# EAGLE board BMS-HVver2.0 (EAGLE 7.6.0), part 1 of 2 (continued)
## Placement (x,y rotation side) (continued)
R188  0  [0603]  30.73,11.96 90 top
R189  16  [RR02J16RTB]  3.17,29.35 180 top
R190  16  [RR02J16RTB]  6.98,32.53 0 top
R191  16  [RR02J16RTB]  3.17,35.7 180 top
R192  16  [RR02J16RTB]  6.98,38.88 0 top
R193  16  [RR02J16RTB]  3.17,42.05 180 top
R194  16  [RR02J16RTB]  6.98,45.23 0 top
R195  16  [RR02J16RTB]  3.17,48.41 180 top
R196  16  [RR02J16RTB]  6.98,51.58 0 top
R197  16  [RR02J16RTB]  3.17,54.76 180 top
R198  16  [RR02J16RTB]  6.98,57.93 0 top
R199  16  [RR02J16RTB]  3.17,61.1 180 top
R200  16  [RR02J16RTB]  6.98,64.28 0 top
R201  16  [RR02J16RTB]  2.54,67.45 180 top
R202  16  [RR02J16RTB]  6.35,70.63 0 top
R203  16  [RR02J16RTB]  2.54,73.81 180 top
R204  16  [RR02J16RTB]  6.35,76.98 0 top
R205  16  [RR02J16RTB]  2.54,80.16 180 top
R206  16  [RR02J16RTB]  6.35,83.33 0 top
R207  16  [RR02J16RTB]  2.54,86.5 180 top
R208  16  [RR02J16RTB]  6.35,89.68 0 top
R209  16  [RR02J16RTB]  2.54,92.86 180 top
R210  16  [RR02J16RTB]  6.35,96.03 0 top
R211  16  [RR02J16RTB]  6.35,102.38 0 top
R212  16  [RR02J16RTB]  2.54,99.2 180 top
R213  1K  [0603]  40.92,55.72 90 top
R214  10K  [MNR14]  44.58,49.27 270 top
R215  100K  [0603]  44.17,55.72 90 top
R216  1.2K  [0603]  47.47,73.53 90 top
R217  787  [0805]  47.47,70.07 90 top
R218  10K-NTC  [NTC-NXRT15XH103FA5B]  37.47,96.28 90 top
R219  10K-NTC  [NTC-NXRT15XH103FA5B]  26.54,69.87 90 top
R220  10K-NTC  [NTC-NXRT15XH103FA5B]  37.47,43.71 90 top
R221  10K-NTC  [NTC-NXRT15XH103FA5B]  26.8,17.29 90 top
SJ1  [PAD-JUMPER-3-NO_YES_SILK]  141.66,43.66 0 top
SJ2  [PAD-JUMPER-3-NO_YES_SILK]  141.66,41.12 0 top
SJ3  [PAD-JUMPER-3-NO_YES_SILK]  141.66,38.58 0 top
SJ4  [PAD-JUMPER-3-NO_YES_SILK]  141.66,36.04 0 top
SJ5  [PAD-JUMPER-2-NO_YES_SILK]  141.22,32.91 0 top
SJ6  [PAD-JUMPER-3-NO_YES_SILK]  100.79,76.52 0 top
SJ7  [PAD-JUMPER-3-NO_YES_SILK]  100.79,73.98 0 top
SJ8  [PAD-JUMPER-3-NO_YES_SILK]  100.79,71.27 0 top
SJ9  [PAD-JUMPER-3-NO_YES_SILK]  100.79,68.72 0 top
SJ10  [PAD-JUMPER-2-NO_YES_SILK]  100.33,66.19 90 top
SJ11  [PAD-JUMPER-3-NO_YES_SILK]  45.06,84.85 0 top
SJ12  [PAD-JUMPER-3-NO_YES_SILK]  45.06,82.14 0 top
SJ13  [PAD-JUMPER-3-NO_YES_SILK]  45.06,79.42 0 top
SJ14  [PAD-JUMPER-3-NO_YES_SILK]  45.06,76.7 0 top
SJ15  [PAD-JUMPER-2-NO_YES_SILK]  44.65,71.16 90 top
TX1  PE-68386NLT  [PE-68386NLT]  147.12,101.75 0 top
TX2  PE-68386NLT  [PE-68386NLT]  146.94,92.22 0 top
TX3  PE-68386NLT  [PE-68386NLT]  147.12,82.69 0 top
U1  LTC6804-2  [SSOP-48]  140.18,65.93 270 top
U2  LTC6804-2  [SSOP-48]  91.44,66.82 270 top
U3  LTC6804-2  [SSOP-48]  37.08,71.27 270 top
U$1  POGOPIN  [POGOPIN]  125.65,11.12 0 top
U$2  POGOPIN  [POGOPIN]  116.08,18.64 0 top
U$3  POGOPIN  [POGOPIN]  126.9,27.37 0 top
U$4  POGOPIN  [POGOPIN]  116.08,36.14 0 top
U$5  POGOPIN  [POGOPIN]  126.92,44.9 0 top
U$6  POGOPIN  [POGOPIN]  116.08,53.64 0 top
U$7  POGOPIN  [POGOPIN]  126.92,62.38 0 top
U$8  POGOPIN  [POGOPIN]  116.08,71.14 0 top
U$9  POGOPIN  [POGOPIN]  126.92,79.88 0 top
U$10  POGOPIN  [POGOPIN]  116.05,88.61 0 top
U$11  POGOPIN  [POGOPIN]  126.92,97.38 0 top
U$12  POGOPIN  [POGOPIN]  116.08,106.11 0 top
U$13  POGOPIN  [POGOPIN]  125.68,113.63 0 top
U$14  POGOPIN  [POGOPIN]  34.87,11.12 0 top
U$15  POGOPIN  [POGOPIN]  25.27,18.61 0 top
U$16  POGOPIN  [POGOPIN]  36.12,27.37 0 top
U$17  POGOPIN  [POGOPIN]  25.27,36.14 0 top
U$18  POGOPIN  [POGOPIN]  36.12,44.87 0 top
U$19  POGOPIN  [POGOPIN]  25.27,53.64 0 top
U$20  POGOPIN  [POGOPIN]  36.12,62.38 0 top
U$21  POGOPIN  [POGOPIN]  25.27,71.14 0 top
U$22  POGOPIN  [POGOPIN]  36.12,79.88 0 top
U$23  POGOPIN  [POGOPIN]  25.27,88.61 0 top
U$24  POGOPIN  [POGOPIN]  36.12,97.38 0 top
U$25  POGOPIN  [POGOPIN]  25.27,106.11 0 top
U$26  POGOPIN  [POGOPIN]  34.87,113.63 0 top
U$27  LOGO16-2-L  [2016-2-LOGO-L]  1.02,21.35 0 top
U$28  NSV1C201MZ4T1G  [SOT223]  41.05,90.65 0 top
U$29  NSV1C201MZ4T1G  [SOT223]  97.16,85.87 0 top
U$30  NSV1C201MZ4T1G  [SOT223]  135.38,91.33 0 top
U$40  POGOPIN  [POGOPIN]  80.26,11.12 0 top
U$41  POGOPIN  [POGOPIN]  70.66,18.61 0 top
U$42  POGOPIN  [POGOPIN]  81.51,27.35 0 top
U$43  POGOPIN  [POGOPIN]  70.66,36.11 0 top
U$44  POGOPIN  [POGOPIN]  81.51,44.85 0 top
U$45  POGOPIN  [POGOPIN]  70.66,53.64 0 top
U$46  POGOPIN  [POGOPIN]  81.51,62.38 0 top
U$47  POGOPIN  [POGOPIN]  70.66,71.11 0 top
U$48  POGOPIN  [POGOPIN]  81.51,79.88 0 top
U$49  POGOPIN  [POGOPIN]  70.66,88.64 0 top
U$50  POGOPIN  [POGOPIN]  81.51,97.38 0 top
U$51  POGOPIN  [POGOPIN]  70.66,106.11 0 top
U$52  POGOPIN  [POGOPIN]  80.26,113.61 0 top

## Tracks (layer width: path | path; a pad name or v marks a point on that pad's centre or on a via)
A0  (via drill 0.5)
  Top 0.178: SJ9.2 100.79,67.66 101.09,67.35 104.65,67.35 105,67.71 v105,68.42 | v96.65,71.09 94.88,71.09 U2.45
  Bottom 0.178: v105,68.42 105,67.53 104.65,67.18 98.96,67.18 98.43,67.71 98.43,70.55 98.25,70.73 97,70.73 v96.65,71.09
A1  (via drill 0.5)
  Top 0.178: SJ8.2 100.79,72.2 101.09,72.51 103.58,72.51 v103.76,72.33 | v98.43,71.62 97.36,71.62 97,71.98 96.29,71.98 95.94,71.62 94.91,71.62 U2.46
  Bottom 0.178: v103.76,72.33 103.76,72.51 103.4,72.69 99.14,72.69 98.78,72.33 98.78,71.98 v98.43,71.62
A2  (via drill 0.5)
  Top 0.178: U2.47 95.85,72.07 96.29,72.51 97.71,72.51 98.25,73.04 v98.25,74.64 | v104.12,74.64 104.12,74.82 103.94,75 101.09,75 100.74,74.64 100.74,74.03 SJ7.2
  Bottom 0.178: v98.25,74.64 v104.12,74.64
A3  (via drill 0.5)
  Top 0.178: U2.48 95.64,72.57 95.94,72.86 95.94,75.53 96.83,76.42 v97.89,76.42 | v104.29,76.42 104.12,76.42 103.05,75.35 101.09,75.35 100.91,75.53 100.91,76.4 SJ6.2
  Bottom 0.178: v97.89,76.42 97.89,76.24 98.78,75.35 103.76,75.35 104.29,75.89 v104.29,76.42
A4  (via drill 0.5)
  Top 0.178: U1.45 147.87,70.18 148.39,69.67 148.39,69.13 148.74,68.78 v149.63,68.78 | v146.96,36.06 146.96,36.95 146.61,37.3 142.16,37.3 141.63,36.77 141.63,36.06 SJ4.2
  Bottom 0.178: v149.63,68.78 147.85,68.78 147.32,68.24 147.32,59.53 148.74,58.11 148.74,46.2 149.1,45.84 149.1,37.84 v146.96,36.06
A5  (via drill 0.5)
  Top 0.178: U1.46 147.9,70.68 148.74,69.84 v149.63,69.84 | v146.96,38.73 146.96,39.62 146.79,39.79 141.99,39.79 141.63,39.44 141.63,38.6 SJ3.2
  Bottom 0.178: v149.63,69.84 147.32,69.84 146.96,69.49 146.96,59.35 148.39,57.93 148.39,46.02 148.56,45.84 148.56,39.97 v146.96,38.73
A6  (via drill 0.5)
  Top 0.178: U1.47 149.36,71.18 v149.63,70.91 | v146.96,41.93 146.96,42.11 146.43,42.46 141.99,42.46 141.63,42.11 141.63,41.14 SJ2.2
  Bottom 0.178: v149.63,70.91 146.79,70.91 146.61,70.73 146.61,59.17 148.03,57.75 148.03,46.02 148.21,45.84 148.21,43.35 v146.96,41.93
A7  (via drill 0.5)
  Top 0.178: U1.48 149.34,71.68 v149.63,71.98 | v146.96,45.66 142.34,45.66 141.81,45.13 141.81,43.81 SJ1.2
  Bottom 0.178: v149.63,71.98 146.61,71.98 146.25,71.62 146.25,58.46 146.61,58.11 147.14,58.11 147.68,57.57 147.68,46.37 v146.96,45.66
A8  (via drill 0.5)
  Top 0.178: SJ14.2 45.06,77.82 45.26,78.02 v52.73,78.02 | U3.45 42.93,75.52 v42.95,75.53
  Bottom 0.178: v42.95,75.53 52.02,75.53 52.73,76.24 v52.73,78.02
A9  (via drill 0.5)
  Top 0.178: SJ13.2 45.06,80.48 45.26,80.69 v52.73,80.69 | U3.46 42.01,76.02 42.24,76.24 42.24,79.09 v42.6,79.44
  Bottom 0.178: v42.6,79.44 51.49,79.44 v52.73,80.69
A10  (via drill 0.5)
  Top 0.178: SJ12.2 45.06,83.33 45.26,83.53 v52.73,83.53 | U3.47 41.45,76.52 41.71,76.78 41.71,83.18 v41.89,83.36
  Bottom 0.178: v41.89,83.36 52.55,83.36 v52.73,83.53
A11  (via drill 0.5)
  Top 0.178: SJ11.2 45.06,86.17 45.26,86.38 v52.73,86.38 | U3.48 40.51,85.53 v41.17,86.2
  Bottom 0.178: v41.17,86.2 52.55,86.2 v52.73,86.38
C0  (via drill 0.5)
  Top 0.178: U2.26 95.75,61.57 arc-45 95.93,61.5 95.94,61.49 95.94,60.35 arc-45 95.86,60.17 95.58,59.89 87.15,59.89 arc45 86.97,59.81 86.69,59.53 86.69,16.96 arc-45 86.62,16.78 85.98,16.15 77.55,16.15 arc45 77.37,16.07 76.73,15.44 | 76.73,15.44 76.73,13.27 arc45 76.81,13.09 R110.2 | 76.73,15.44 76.73,15.86 arc45 76.66,16.04 76.56,16.15 v76.56,17.04
  Bottom 0.178: C57.1 C55.2 76.03,41.46 arc-45 76.21,41.39 76.73,40.86 76.73,39.54 arc45 76.81,39.36 77.09,39.08 82.14,39.08 arc-45 82.32,39.01 83.13,38.19 83.13,28.34 arc45 83.21,28.16 83.49,27.88 83.49,18.92 arc-45 83.42,18.74 82.78,18.1 77.73,18.1 arc45 77.55,18.03 v76.56,17.04
C1  (via drill 0.5)
  Top 0.178: v79.05,34.74 79.05,32.62 | U2.24 86.38,61.07 arc45 86.2,61 85.98,60.77 85.98,33.32 arc-45 85.91,33.14 85.45,32.68 79.21,32.68 arc45 79.03,32.61 R107.2
  Top 0.406: 79.05,32.62 R107.2
  Bottom 0.178: C53.2 C55.1 | 74.46,43.16 74.17,42.87 74.17,35.96 74.98,35.15 78.64,35.15 v79.05,34.74
  Bottom 0.406: C55.1 74.46,43.16
C2  (via drill 0.5)
  Top 0.178: v79.05,44.9 79.01,44.86 R104.2 79.11,39.62 84.38,39.62 85.27,40.51 85.27,61.66 85.67,62.07 U2.22
  Bottom 0.178: C51.2 C53.1 | v79.05,44.9 79.05,46.93 78.64,47.34 75.32,47.34
  Bottom 0.406: 75.32,47.34 C53.1
C3  (via drill 0.5)
  Top 0.178: R101.2 78.95,49.69 v79.05,49.78 79.07,49.75 84.02,49.75 84.56,50.28 84.56,62.73 84.9,63.07 U2.20
  Bottom 0.178: C49.2 C51.1 | v79.05,49.78 76.61,49.78 76.2,50.18 76.2,51.4 75.79,51.81 75.2,51.81
  Bottom 0.406: 75.2,51.81 C51.1
C4  (via drill 0.5)
  Top 0.178: R98.2 78.95,55.78 v79.05,55.87 79.15,55.97 83.67,55.97 83.84,56.15 83.84,63.8 84.12,64.07 U2.18
  Bottom 0.178: C47.2 C49.1 | v79.05,55.87 77.01,55.87 76.61,56.28 75.27,56.28
  Bottom 0.406: 75.27,56.28 C49.1
C5  (via drill 0.5)
  Top 0.178: 79.05,59.92 v79.05,61.16 80.09,61.16 80.65,60.6 82.6,60.6 83.13,61.13 83.13,64.69 83.49,65.04 87.99,65.04 U2.16
  Top 0.406: 79.05,59.92 R92.2
  Bottom 0.178: C43.2 C47.1 78.57,60.69 v79.05,61.16
C6  (via drill 0.5)
  Top 0.178: v80.26,66.84 82.58,66.84 83.31,66.11 87.98,66.11 U2.14
  Top 0.406: v80.26,66.84 78.98,66.84 R95.2
  Bottom 0.178: C43.1 C45.2 79.49,67.62 v80.26,66.84
C7  (via drill 0.5)
  Top 0.178: v79.05,73.35 78.95,73.26 R89.2 82.14,71.9 82.96,71.09 82.96,67.53 83.49,67 87.95,67 U2.12
  Bottom 0.178: C41.2 C45.1 | v79.05,73.35 79.05,72.13 78.64,71.72 75.4,71.72
  Bottom 0.406: 75.4,71.72 C41.2
C8  (via drill 0.5)
  Top 0.178: 79.05,78.34 v79.05,76.6 83.31,76.6 83.67,76.24 83.67,68.78 84.38,68.06 U2.10
  Top 0.406: 79.05,78.34 R86.2
  Bottom 0.178: C41.1 C39.2 78.88,76.77 v79.05,76.6
C9  (via drill 0.5)
  Top 0.178: R83.2 80.54,84.6 v80.67,84.73 80.72,84.78 83.84,84.78 84.38,84.24 84.38,69.49 84.8,69.07 U2.8
  Bottom 0.178: C37.2 C39.1 | v80.67,84.73 80.67,83.91 80.26,83.51 77.01,83.51 76.61,83.1 76.61,81.48 76.2,81.07 75.2,81.07
  Bottom 0.406: 75.2,81.07 C37.2
C10  (via drill 0.5)
  Top 0.178: R77.2 80.59,89.68 v80.67,89.6 80.7,89.58 84.56,89.58 85.09,89.05 85.09,70.38 85.4,70.07 U2.6
  Bottom 0.178: C34.2 C37.1 | v80.67,89.6 80.67,86.35 80.26,85.95 75.48,85.95
  Bottom 0.406: 75.48,85.95 C34.2
C11  (via drill 0.5)
  Top 0.178: R78.2 78.21,95.27 v78.23,95.29 78.26,95.27 85.27,95.27 85.8,94.73 85.8,71.44 86.17,71.07 U2.4
  Bottom 0.178: C33.2 C34.1 | v78.23,95.29 78.23,90.82 77.83,90.42 75.37,90.42
  Bottom 0.406: 75.37,90.42 C33.2
C12  (via drill 0.5)
  Top 0.178: 76.54,103.45 v77.98,103.45 85.98,103.45 86.51,102.91 86.51,72.33 86.77,72.07 U2.2
  Top 0.406: 76.54,103.45 R76.2
  Bottom 0.178: C33.1 75.18,95.67 75.84,96.34 77.8,96.34 78.16,96.69 78.16,103.27
  Bottom 0.406: 78.16,103.27 v77.98,103.45
C13  (via drill 0.5)
  Top 0.178: R4.2 129.51,103.65 | U1.2 135.85,71.18 135.41,71.62 135.41,88.87 135.05,89.22 134.52,89.22 134.16,89.58 134.16,103.45 133.99,103.62 v129.54,103.62
  Top 0.406: 129.51,103.65 v129.54,103.62
  Bottom 0.178: v129.54,103.62 129.54,102.74 129.01,102.2 122.96,102.2 122.43,101.67 C3.1
C14  (via drill 0.5)
  Top 0.178: R6.2 129.21,94.58 v129.36,94.73 133.1,94.73 133.45,94.38 133.45,89.22 134.7,87.98 134.7,70.73 135.25,70.18 U1.4
  Bottom 0.178: C4.1 C3.2 | v129.36,94.73 129.36,91.18 129.01,90.82 126.52,90.82 126.16,90.47 122.44,90.47
  Bottom 0.406: 122.44,90.47 C3.2
C15  (via drill 0.5)
  Top 0.178: R11.2 v129.36,84.6 132.74,84.6 133.27,84.07 133.27,69.31 134.4,68.18 U1.8
  Bottom 0.178: C9.1 C7.2 | v129.36,84.6 129.36,82.82 129.01,82.47 122.54,82.47
  Bottom 0.406: 122.54,82.47 C7.2
C16  (via drill 0.5)
  Top 0.178: 127.9,68.78 v129.36,68.78 131.14,68.78 131.67,68.24 131.67,67.35 132.85,66.18 U1.12
  Top 0.406: 127.9,68.78 R17.2
  Bottom 0.178: C11.2 C15.1 124.86,71.86 125.27,71.44 125.27,69.31 125.63,68.95 129.18,68.95 v129.36,68.78
C17  (via drill 0.5)
  Top 0.178: R23.2 129.13,59.84 v129.18,59.89 129.18,64.69 129.68,65.18 U1.14
  Bottom 0.178: C13.1 C15.2 | v129.18,59.89 129.18,63.98 128.83,64.33 124.03,64.33 123.67,64.69 123.67,67.53 123.5,67.71 122.52,67.71
  Bottom 0.406: 122.52,67.71 C13.1
C18  (via drill 0.5)
  Top 0.178: R20.2 129.29,55.01 v129.36,55.09 130.07,55.09 130.43,55.44 130.43,63.8 130.81,64.18 U1.16
  Bottom 0.178: C17.1 C13.2 | v129.36,55.09 129.36,58.46 129.01,58.82 128.47,58.82 127.94,59.35 125.27,59.35 124.92,59.71 124.92,63.09 124.56,63.44 122.47,63.44
  Bottom 0.406: 122.47,63.44 C17.1
C19  (via drill 0.5)
  Top 0.178: R29.2 129.31,42.05 v129.36,42.11 131.32,42.11 131.85,42.64 131.85,61.84 132.19,62.18 U1.20
  Bottom 0.178: C23.1 C19.2 | v129.36,42.11 126.16,42.11 125.09,43.17 125.09,54.02 124.74,54.37 123.5,54.37 122.96,54.91 122.49,54.91
  Bottom 0.406: 122.49,54.91 C23.1
C20  (via drill 0.5)
  Top 0.178: 127.86,38.63 127.05,39.44 127.05,43 126.87,43.17 125.63,43.17 124.92,43.88 124.92,45.84 v124.03,46.73 | U1.22 132.97,61.18 132.56,60.77 132.56,39.26 132.03,38.73 128,38.73 R32.2
  Top 0.406: R32.2 127.86,38.63
  Bottom 0.178: C25.1 C23.2 | v124.03,46.73 124.03,50.28 123.5,50.82 122.47,50.82
  Bottom 0.406: 122.47,50.82 C25.1
C21  (via drill 0.5)
  Top 0.178: v120.65,47.08 120.65,47.62 120.83,47.8 121.9,47.8 122.07,47.97 122.07,48.68 122.43,49.04 v130.25,49.04 | 127.95,34.46 v129.36,34.46 129.54,34.28 132.74,34.28 133.27,34.82 133.27,59.89 133.57,60.18 U1.24
  Top 0.406: 127.95,34.46 R35.2
  Bottom 0.178: C25.2 C27.1 120.99,46.21 120.65,46.55 v120.65,47.08 | v130.25,49.04 130.25,35.35 v129.36,34.46
C22  (via drill 0.5)
  Top 0.178: R5.2 129.46,89.68 v129.54,89.76 132.38,89.76 132.74,89.4 132.74,88.87 133.99,87.62 133.99,69.84 134.65,69.18 U1.6
  Bottom 0.178: C7.1 C4.2 | v129.54,89.76 129.54,87.09 129.01,86.56 122.57,86.56
  Bottom 0.406: 122.57,86.56 C4.2
C23  (via drill 0.5)
  Top 0.178: R38.2 125.22,24.38 123.67,25.93 123.67,29.13 123.5,29.3 | 123.5,29.3 v123.14,29.66 | U1.26 144.57,60.68 144.65,60.6 144.65,59.89 144.48,59.71 139.14,59.71 138.79,59.35 134.34,59.35 133.99,59 133.99,30.37 133.27,29.66 123.85,29.66 123.5,29.3
  Bottom 0.178: C29.1 C27.2 | v123.14,29.66 123.14,38.55 123.85,39.26 123.85,41.04 123.5,41.39 122.44,41.39
  Bottom 0.406: 122.44,41.39 C29.1
C24  (via drill 0.5)
  Top 0.178: v120.83,63.62 120.83,61.84 121.72,60.95 121.72,58.46 122.07,58.11 123.14,58.11 123.5,57.75 123.5,56.69 124.03,56.15 v124.38,56.15 | U1.18 131.41,63.18 131.14,62.91 131.14,51.35 130.78,51 v129.36,51 129.36,50.28 129.18,50.11 127.93,50.11
  Top 0.406: 127.93,50.11 R26.2
  Bottom 0.178: C19.1 C17.2 121.78,61.78 121.36,62.2 121.36,63.09 v120.83,63.62 | v129.36,51 127.41,51 126.87,51.35 126.87,55.8 126.52,56.15 v124.38,56.15
C25  (via drill 0.5)
  Top 0.178: R14.2 129.08,76.34 | U1.10 133.45,67.18 132.56,68.06 132.56,75.71 132.03,76.24 v129.18,76.24
  Top 0.406: 129.08,76.34 v129.18,76.24
  Bottom 0.178: C9.2 C11.1 123.46,76.95 128.83,76.95 129.18,76.6
  Bottom 0.406: v129.18,76.24 129.18,76.6
C26  (via drill 0.5)
  Top 0.178: 23.84,100.98 24.64,100.98 24.89,100.73 v24.89,99.71 30.86,99.71 31.3,99.27 31.3,76.87 31.66,76.52 U3.2
  Top 0.406: 23.84,100.98 R151.2
  Bottom 0.178: C65.1 24.47,98.78 24.89,99.2 v24.89,99.71
C27  (via drill 0.5)
  Top 0.178: 23.89,94.63 24.64,94.63 24.89,94.38 v24.89,93.62 25.3,93.67 30.06,93.67 30.42,93.31 30.42,75.89 30.7,75.52 U3.4
  Top 0.406: 23.89,94.63 R153.2
  Bottom 0.178: C65.2 C66.1 24.45,93.7 v24.89,93.62
C28  (via drill 0.5)
  Top 0.178: 23.84,80.66 24.64,80.66 24.89,80.92 v24.89,81.93 28.28,81.93 28.64,81.58 28.64,73.75 28.88,73.52 U3.8
  Top 0.406: 23.84,80.66 R158.2
  Bottom 0.178: C71.1 C69.2 24.5,82.58 24.89,82.19 v24.89,81.93
C29  (via drill 0.5)
  Top 0.178: v25.15,66.95 25.15,67.71 24.89,67.96 23.84,67.96 | U3.12 27.82,71.52 27.57,71.27 27.57,67.18 27.3,66.91 25.18,66.91 v25.15,66.95 | 25.2,67 v25.15,66.95
  Top 0.406: 23.84,67.96 R164.2
  Bottom 0.178: C77.1 C73.2 20.54,69.78 20.83,69.49 20.83,67.2 21.08,66.95 v25.15,66.95
C30  (via drill 0.5)
  Top 0.178: R170.2 25.02,63.01 25.15,63.14 v25.15,64.41 25.25,64.51 28.11,64.51 28.46,64.86 28.46,70.2 28.78,70.52 U3.14
  Bottom 0.178: C77.2 C75.1 | v25.15,64.41 24.64,64.41 24.38,64.15 24.38,61.87 24.13,61.61 20.83,61.61 20.57,61.87 20.57,63.65 20.32,63.9 19.85,63.9
  Bottom 0.406: 19.85,63.9 C77.2
C31  (via drill 0.5)
  Top 0.178: 23.84,58.31 24.64,58.31 24.89,58.06 v24.89,57.3 24.99,57.4 28.99,57.4 29.35,57.75 29.35,69.13 29.73,69.52 U3.16
  Top 0.406: 23.84,58.31 R167.2
  Bottom 0.178: C79.1 C75.2 20.41,58.98 20.57,58.82 20.57,57.55 20.83,57.3 v24.89,57.3
C32  (via drill 0.5)
  Top 0.178: R176.2 24.64,43.33 24.89,43.07 v24.89,42.31 24.92,42.28 30.68,42.28 31.04,42.64 31.04,67.35 31.2,67.52 U3.20
  Bottom 0.178: C83.1 C81.2 19.69,43.2 20.83,42.05 24.64,42.05 v24.89,42.31
C33  (via drill 0.5)
  Top 0.178: R179.2 25.02,38.63 25.15,38.75 v25.15,39.77 25.17,39.79 31.39,39.79 31.75,40.15 31.75,66.29 31.98,66.52 U3.22
  Bottom 0.178: C83.2 C85.1 | v25.15,39.77 23.11,39.77 22.86,39.52 22.86,36.72 22.61,36.47 20.83,36.47 20.57,36.72 19.72,36.72
  Bottom 0.406: 19.72,36.72 C83.2
C34  (via drill 0.5)
  Top 0.178: 23.89,32.15 24.64,32.15 24.89,31.89 v24.89,31.39 24.94,31.44 32.11,31.44 32.46,31.79 32.46,65.22 32.76,65.52 U3.24
  Top 0.406: 23.89,32.15 R182.2
  Bottom 0.178: C87.1 C85.2 19.69,29.23 20.32,28.59 22.61,28.59 22.86,28.85 22.86,30.88 23.11,31.13 24.64,31.13 v24.89,31.39
C35  (via drill 0.5)
  Top 0.178: 23.84,85.74 24.89,85.74 25.15,85.49 v25.15,84.47 25.2,84.42 29.17,84.42 29.53,84.07 29.53,74.82 29.83,74.52 U3.6
  Top 0.406: 23.84,85.74 R152.2
  Bottom 0.178: C66.2 C69.1 22.42,84.28 22.61,84.47 22.61,86.76 22.86,87.01 24.13,87.01 24.38,86.76 24.38,84.73 24.64,84.47 v25.15,84.47
C36  (via drill 0.5)
  Top 0.178: v33.35,17.21 33.17,17.39 33.17,64.33 33.35,64.51 38.33,64.51 38.86,65.04 41.53,65.04 41.71,65.22 41.71,65.66 41.35,65.93 40.59,65.93 U3.26
  Bottom 0.178: C87.2 C89.1
  Bottom 0.406: R185.2 34.8,17.04 | 34.8,17.04 34.8,20.97 34.29,21.48 24.64,21.48 24.38,21.73 21.34,21.73 21.08,21.99 21.08,22.75 20.83,23.01 19.9,23.01 C89.1 | v33.35,17.21 34.62,17.21 34.8,17.04
C37  (via drill 0.5)
  Top 0.178: R173.2 24.64,49.67 24.89,49.93 v24.89,50.95 24.94,51 29.88,51 30.24,51.35 30.24,68.24 30.51,68.52 U3.18
  Bottom 0.178: C81.1 C79.2 24.73,51.37 24.89,51.2 v24.89,50.95
C38  (via drill 0.5)
  Top 0.178: R161.2 24.89,76.34 25.15,76.09 v25.15,75.33 27.3,75.33 27.83,74.81 27.83,72.7 28.01,72.52 U3.10
  Bottom 0.178: C73.1 C71.2 24.98,76.77 25.15,76.6 v25.15,75.33
DRIVE
  Top 0.178: U2.38 93.13,67.57 92.56,67 91.14,67 90.25,67.89 90.25,76.07 90.78,76.6 93.8,76.6 94.87,77.67 94.87,79.98 94.69,80.16 94.69,83.36 95.4,84.07 96.83,84.07 97,84.24 97,85.72 U$29.P$1
DRIVE1
  Top 0.178: U1.38 140.35,66.68 140.03,67 140.03,73.22 139.85,73.4 139.85,78.73 139.5,79.09 138.07,79.09 137.9,79.27 137.9,81.04 137.54,81.4 136.47,81.4 135.94,81.93 135.94,89.4 135.41,89.93 135.41,91.31 U$30.P$1
DRIVE2  (via drill 0.5)
  Top 0.178: U3.38 41.92,72.02 v42.06,72.15 | v41,88.69 41,90.59 U$28.P$1
  Bottom 0.178: v42.06,72.15 42.06,78.56 41.53,79.09 41.53,82.11 41.17,82.47 40.46,82.47 40.11,82.82 40.11,87.8 v41,88.69
GND  (via drill 0.5)
  Top 0.178: v38.68,68.24 39.04,68.24 39.4,68.6 40.42,68.6 U3.31
  other vias: 40.28,61.49
  pour Top: -1.27,125.88 54.86,125.88 54.86,-1.12 -1.27,-1.12
  pour Bottom: -1.27,125.88 54.86,125.88 54.86,-1.12 -1.27,-1.12
GNDA  (via drill 0.5)  (1 unrouted)
  Top 0.178: U2.30 U2.31 93.01,64.07 v92.91,65.93
  other vias: 98.78,59.35 80.29,35.53 83.31,41.75 74.24,18.99 103.4,70.55 97.18,81.93
  pour Top: 56.9,127.4 56.9,-2.65 105.31,-2.65 105.31,127.4
  pour Bottom: 56.9,125.37 56.9,-2.65 105.31,-2.65 105.31,125.37
GNDI  (via drill 0.5)  (3 unrouted)
  Top 0.178: U1.31 U1.30 | 145.36,45.31 143.76,43.71 142.52,43.71 SJ1.3
  other vias: 140.92,72.51
  pour Top: 106.78,125.85 106.78,-0.92 153.19,-0.92 153.19,77.49 147.5,77.49 147.5,129.41 106.78,129.41
  pour Bottom: 106.78,129.41 106.78,131.36 147.5,131.36 147.5,77.67 153.72,77.67 153.72,-1.46 106.78,-1.46 106.78,2.28
GPIO1  (via drill 0.5)
  Top 0.178: U2.27 92.86,62.07 v92.73,62.2 | v92.2,47.44 92.2,44.77 91.67,44.24 91.67,41.33 R139.1
  Bottom 0.178: v92.2,47.44 92.73,47.97 v92.73,62.2 92.73,63.62 92.2,64.15 84.73,64.15 84.02,64.86 84.02,95.98 83.84,96.16 82.94,96.16 R143.P$2
GPIO2  (via drill 0.5)
  Top 0.178: v92.91,44.06 93.27,44.42 93.27,46.37 94.16,47.26 94.16,51.35 96.29,53.48 96.29,62.2 95.92,62.57 U2.28 93.78,62.57 93.45,62.91 93.45,63.26 90.6,63.26 90.42,63.09 v90.42,62.55 | R139.2 93.45,40.4 93.45,38.91 v93.27,38.73
  Bottom 0.178: v92.91,44.06 92.91,39.26 v93.27,38.73 | v90.42,62.55 83.84,62.55 83.67,62.73 83.67,67.18 82.42,68.42 74.24,68.42 73.71,68.95 73.71,72.15 73.36,72.51 72.15,72.51 R144.P$2
GPIO3  (via drill 0.5)
  Top 0.178: U2.29 95.95,63.07 96.65,62.38 96.65,53.31 94.87,51.53 94.87,46.55 v94.16,45.84 | v94.16,37.3 94.16,40.49 R139.3
  Bottom 0.178: v94.16,37.3 v94.16,45.84 93.92,46.08 R145.P$2
GPIO4  (via drill 0.5)
  Top 0.178: U2.32 96.05,64.57 96.29,64.33 96.29,63.26 97,62.55 97,52.6 96.29,51.88 95.76,51.88 95.4,51.53 v95.4,44.24 | v95.05,33.93 95.05,40.45 R139.4 | R146.P$2 72.14,20.97 72.47,21.3 84.56,21.3 v85.09,21.84
  Bottom 0.178: v95.4,44.24 95.4,34.46 v95.05,33.93 95.05,22.73 94.16,21.84 v85.09,21.84
GPIO5
  Top 0.178: U2.33 96.26,65.07 96.65,64.69 96.65,63.44 97.36,62.73 97.36,55.97 98.43,54.91 R138.2
GPIO6  (via drill 0.5)
  Top 0.178: v146.43,53.66 146.07,53.66 145.54,54.2 145.54,60.95 144.81,61.68 U1.28 143.59,61.66 142.16,61.66 141.81,62.02 v141.45,62.02 | v144.3,53.66 143.21,53.66 R67.2 | v124.03,70.2 129.01,70.2 v129.72,70.91
  Bottom 0.178: v146.43,53.66 v144.3,53.66 | R72.P$2 120.74,72.24 121.01,71.98 121.01,71.27 121.18,71.09 123.85,71.09 124.03,70.91 v124.03,70.2 | v129.72,70.91 135.05,70.91 135.76,70.2 135.76,62.73 136.65,61.84 141.28,61.84 v141.45,62.02
GPIO7  (via drill 0.5)
  Top 0.178: R67.1 143.17,52.77 144.65,52.77 145.19,53.31 145.19,60.6 144.6,61.18 U1.27 143.55,61.13 139.68,61.13 139.32,61.49 v139.32,63.09
  Bottom 0.178: R71.P$2 135.75,98.66 136.12,98.29 136.12,80.33 135.94,80.16 135.94,70.55 136.12,70.38 136.12,63.26 136.65,62.73 138.96,62.73 v139.32,63.09
GPIO8  (via drill 0.5)
  Top 0.178: v146.79,57.04 146.43,57.4 146.43,63.44 146.19,63.68 U1.32 | v143.23,56.69 143.23,55.33 R67.4
  Bottom 0.178: v146.79,57.04 145.54,57.04 145.19,57.4 145.19,58.82 144.83,59.17 143.76,59.17 143.41,58.82 143.41,56.86 v143.23,56.69 143.05,56.51 143.05,46.91 142.7,46.55 138.79,46.55 137.9,45.66 137.9,17.75 137.31,17.16 R147.P$2
GPIO9  (via drill 0.5)
  Top 0.178: U1.29 145.65,62.18 145.99,61.84 145.99,55.62 v146.43,55.26 | R67.3 143.16,54.37 144.12,54.37 144.3,54.55 v144.3,58.11 144.12,58.29 v135.23,58.29
  Bottom 0.178: v146.43,55.26 144.83,55.26 144.65,55.44 144.65,57.75 v144.3,58.11 | R73.P$2 128.27,49.37 128.65,49.75 129.54,49.75 129.9,50.11 134.16,50.11 134.52,50.46 134.52,57.93 134.87,58.29 v135.23,58.29
GPIO10
  Top 0.178: R66.2 142.81,51.35 147.14,51.35 147.85,52.06 147.85,57.57 147.68,57.75 147.32,57.75 146.79,58.29 146.79,64.06 146.67,64.18 U1.33
GPIO11  (via drill 0.5)
  Top 0.178: v35.84,68.06 35.84,67.18 36.02,67 40.49,67 U3.28 41.87,67.02 42.24,66.64 42.24,63.8 41.71,63.26 39.04,63.26 38.86,63.09 38.86,50.11 v38.51,49.75 | v40.46,49.93 41.89,49.93 42.24,49.57 43.58,49.57 R214.2
  Bottom 0.178: R219.P$2 35.62,72.37 35.84,72.15 v35.84,68.06 | v38.51,49.75 40.28,49.75 v40.46,49.93
GPIO12  (via drill 0.5)
  Top 0.178: R214.1 42.18,50.52 41.89,50.82 v41.89,51 | v37.62,66.11 37.62,66.29 37.8,66.46 40.45,66.46 U3.27
  Bottom 0.178: v41.89,51 38.15,51 37.44,51.71 37.44,60.95 37.8,61.31 37.8,65.93 v37.62,66.11 37.62,70.91 38.51,71.8 38.51,98.65 38.37,98.78 R218.P$2
GPIO13  (via drill 0.5)
  Top 0.178: R221.P$2 26.8,29.15 27.13,29.48 v32.11,29.48 | 42.77,46.2 42.77,43 42.06,42.28 35.57,42.28 34.86,41.57 v34.86,29.48 | 42.77,46.2 42.77,47.62 43.13,47.97 43.63,47.97 R214.4 | U3.32 41.82,69.02 43.13,67.71 43.13,65.22 42.95,65.04 42.95,62.73 42.42,62.2 42.42,59.89 v41.53,59 | v44.02,46.2 42.77,46.2
  Bottom 0.178: v32.11,29.48 v34.86,29.48 | v41.53,59 41.53,52.77 42.06,52.24 43.13,52.24 43.66,51.71 43.66,46.55 v44.02,46.2
GPIO14
  Top 0.178: R220.P$2 37.47,48.35 37.97,48.86 38.86,48.86 | 38.86,48.86 R214.3 | U3.29 42.43,67.52 42.6,67.35 42.6,63.26 42.24,62.91 39.4,62.91 39.22,62.73 39.22,49.22 38.86,48.86
GPIO15
  Top 0.178: U3.33 41.86,69.52 43.48,67.89 43.48,65.22 43.31,65.04 43.31,62.73 42.77,62.2 42.77,56.86 42.6,56.69 41.04,56.69 R213.2
IBIAS  (via drill 0.5)
  Top 0.178: v92.02,70.91 93.09,70.91 93.45,70.55 94.84,70.55 U2.44
  Bottom 0.178: R141.2 92.02,70.84 v92.02,70.91
IBIAS1
  Top 0.178: U1.44 147.3,69.68 149.1,67.89 150.7,67.89 151.05,67.53 151.05,18.81 150.7,18.46 140.56,18.46 140.21,18.81 140.21,21.01 R69.2
IBIAS2
  Top 0.178: U3.44 42.22,75.02 42.42,74.82 47.03,74.82 R216.2
ICMP  (via drill 0.5)
  Top 0.178: v92.02,69.13 92.2,69.13 93.09,70.02 94.81,70.02 U2.43
  Bottom 0.178: v92.02,69.13 v92.01,69.14 R141.1 R142.2
ICMP1  (via drill 0.5)
  Top 0.178: R70.2 142,23.03 R69.1 142.02,21.12 v143.76,21.12 | U1.43 147.27,69.18 148.92,67.53 150.34,67.53 150.7,67.18 150.7,19.88 v150.17,19.35
  Bottom 0.178: v150.17,19.35 144.12,19.35 143.94,19.52 143.94,20.95 v143.76,21.12
ICMP2
  Top 0.178: R217.2 R216.1 47.46,72.69 46.86,72.69 46.51,73.04 46.51,73.75 45.97,74.29 41.89,74.29 41.66,74.52 U3.43
IMA  (1 unrouted)
  Top 0.178: U2.41 93.56,69.07 93.27,68.78 93.27,68.24 92.38,67.35 91.31,67.35 90.6,68.06 90.6,74.11 91.31,74.82
IMA1
  Top 0.178: U1.41 142.58,68.18 142.34,68.42 142.34,79.62 141.81,80.16 140.74,80.16 140.39,80.51 140.39,88.69 141.45,89.76 143.49,89.76 TX2.3
IMA2  (1 unrouted)
IPA  (1 unrouted)
  Top 0.178: U2.42 93.17,69.57 92.91,69.31 92.91,68.6 92.2,67.89 91.49,67.89 91.14,68.24 91.14,73.93 91.67,74.47
IPA1  (via drill 0.5)
  Top 0.178: U1.42 145.1,68.68 v145.36,68.42 | v141.99,94.91 143.41,94.91 TX2.1
  Bottom 0.178: v145.36,68.42 145.36,94.56 145.01,94.91 v141.99,94.91
IPA2  (1 unrouted)
N$1
  Top 0.406: Q12.1 122.99,102.06 arc-45 123.17,101.99 124.03,101.13 126.09,101.13 arc-45 R7.1
N$2
  Top 0.406: R64.P$2 108.48,99.2 arc45 108.66,99.28 R65.P$2 114.86,102.38 arc45 115.03,102.45 115.32,102.74 116.55,102.74 arc45 116.73,102.81 D1.A 119.35,102.92 arc45 119.53,103 Q12.3
N$3
  Top 0.406: R9.2 116.83,100.82 arc45 D1.C
N$4
  Top 0.406: R64.P$1 114.62,99.2 arc-45 114.79,99.13 R9.1 114.85,99.08 arc45 115.03,99 122.07,99 122.59,98.48 arc-45 122.67,98.3 Q11.2 124.34,96.09 arc-45 124.52,96.02 124.74,95.8 124.74,95.19 arc45 124.81,95.02 125.09,94.73 126.09,94.73 arc45 R6.1
  Bottom 0.406: R65.P$1 108.42,102.38 arc-45 108.6,102.31 R64.P$1 111.83,99.08 arc45 112.01,99 115.67,99 116.13,99.46 arc45 116.21,99.64 F26.2
N$5
  Top 0.406: Q11.1 124.11,94.19 arc-45 124.29,94.12 124.56,93.85 124.56,92.71 arc45 124.64,92.53 124.92,92.25 126.09,92.25 arc-45 R8.1
N$6
  Top 0.406: R62.P$2 108.48,92.86 arc45 108.66,92.93 R63.P$2 114.55,96.03 arc45 114.73,96.1 115.14,96.51 116.7,96.51 arc45 D2.A 120.13,96.57 arc-45 120.31,96.5 120.65,96.16 120.65,95.33 arc-45 Q11.3
N$7
  Top 0.406: R10.2 116.83,94.47 arc45 D2.C
N$8
  Top 0.406: R62.P$1 114.87,92.86 arc-45 115.05,92.78 R10.1 121.27,92.77 arc-45 121.45,92.69 121.9,92.25 121.9,91.28 arc45 121.97,91.1 122.43,90.64 123.75,90.64 arc-45 123.93,90.57 124.03,90.47 124.03,89.57 arc45 Q10.2 125.85,89.49 arc45 126.03,89.56 R5.1
  Bottom 0.406: R63.P$1 108.42,96.03 arc-45 108.6,95.96 R62.P$1 arc-45 111.76,92.71 111.76,91.71 112.04,91.43 arc45 112.22,91.36 125.81,91.36 126.67,92.22 arc45 126.75,92.4 F27.2
N$9
  Top 0.406: Q10.1 124.67,87.59 arc-45 124.85,87.51 125.27,87.09 126.03,87.09 arc45 R12.1
N$10
  Top 0.406: R60.P$2 108.48,86.5 arc45 108.66,86.58 R61.P$2 111.76,90.36 arc-45 111.83,90.54 112.29,91 119.3,91 arc-45 119.48,90.93 119.94,90.47 119.94,89.58 arc-45 D3.A 121.73,89.46 arc-45 121.91,89.39 122.07,89.22 122.07,88.75 arc-45 122,88.57 Q10.3
N$11
  Top 0.406: R13.2 119.27,86.85 arc45 119.45,86.92 D3.C
N$12
  Top 0.406: R60.P$1 115.8,86.5 arc-45 115.97,86.43 116.74,85.67 117.23,85.67 arc-45 117.41,85.59 R13.1 121.95,85.15 arc-45 122.13,85.07 Q9.2 125.85,84.41 arc45 126.03,84.48 R11.1
  Bottom 0.406: R61.P$1 108.42,89.68 arc-45 108.6,89.61 R60.P$1 115.67,86.5 116,86.17 arc-45 116.08,85.99 F28.2
N$13
  Top 0.406: Q9.1 125.6,82.51 arc-45 125.78,82.43 R15.1
N$14
  Top 0.406: R58.P$2 108.48,80.16 arc45 108.66,80.23 R59.P$2 116.96,83.33 arc45 117.13,83.4 D4.A 120.43,83.62 arc-45 120.61,83.54 Q9.3
N$15
  Top 0.406: R16.2 116.99,81.77 arc-45 117.17,81.69 D4.C
N$16
  Top 0.406: R58.P$1 114.74,80.16 arc-45 114.92,80.08 R16.1 121.88,80.07 arc-45 122.06,79.99 122.78,79.27 122.78,76.56 arc45 Q8.2 125.86,76.53 arc-45 126.04,76.46 R14.1
  Bottom 0.406: R59.P$1 108.42,83.33 arc-45 108.6,83.26 R58.P$1 111.71,80.14 arc45 111.89,80.07 120.65,80.07 121.11,79.61 arc-45 121.18,79.43 121.18,75.53 121.47,75.25 arc45 121.64,75.18 123.32,75.18 124.07,75.93 arc-45 124.25,76 F29.2
N$17
  Top 0.406: Q8.1 123.93,74.63 arc-45 124.11,74.56 124.92,73.75 126.03,73.75 arc45 R18.1
N$18
  Top 0.406: R56.P$2 108.48,73.81 arc45 108.66,73.88 R57.P$2 114.7,76.98 arc45 114.88,77.05 115.67,77.84 117.21,77.84 arc45 D5.A 118.89,77.9 arc-45 119.06,77.83 119.41,77.49 119.41,76.17 arc45 119.48,75.99 119.94,75.53 120.57,75.53 arc45 Q8.3
N$19
  Top 0.406: R19.2 116.98,75.54 arc45 117.16,75.62 D5.C
N$20
  Top 0.406: Q6.1 123.6,59.14 arc-45 123.78,59.06 124.21,58.64 124.21,57.86 arc45 124.28,57.68 124.56,57.4 125.94,57.4 arc-45 126.12,57.32 R21.1
N$21
  Top 0.406: R52.P$2 108.48,61.1 arc45 108.66,61.18 R53.P$2 116.01,64.28 arc-45 116.19,64.21 D6.A 117.13,63.26 118.16,63.26 118.34,63.09 118.34,60.6 118.85,60.09 Q6.3
N$22
  Top 0.406: R22.2 115.47,62.72 arc-45 115.65,62.64 D6.C
N$23
  Top 0.406: R56.P$1 114.84,73.81 arc45 R19.1 119.39,73.84 arc-45 119.57,73.77 120.12,73.22 120.12,69.95 arc45 120.19,69.77 120.47,69.49 122.5,69.49 arc-45 122.68,69.41 122.96,69.13 122.96,68.5 arc-45 Q7.2 125.72,68.41 arc45 125.9,68.48 R17.1
  Bottom 0.406: R57.P$1 108.42,76.98 arc-45 108.6,76.91 R56.P$1 arc45 111.76,73.95 111.76,75.18 111.93,75.34 arc-45 112.11,75.42 F30.2
N$24
  Top 0.406: Q7.1 125.72,66.5 arc-45 125.9,66.43 R24.1
N$25
  Top 0.406: R54.P$2 108.48,67.45 arc45 108.66,67.53 R55.P$2 113.89,70.63 arc-45 114.07,70.56 115.49,69.13 116.63,69.13 arc-45 116.81,69.06 117.09,68.78 D7.A 120.17,68 arc-45 120.35,67.92 Q7.3
N$26